# EasyEDA Pro project Cerberus_Sub_Controller_v02.eprj, board Cerberus_Sub_Controller_v02
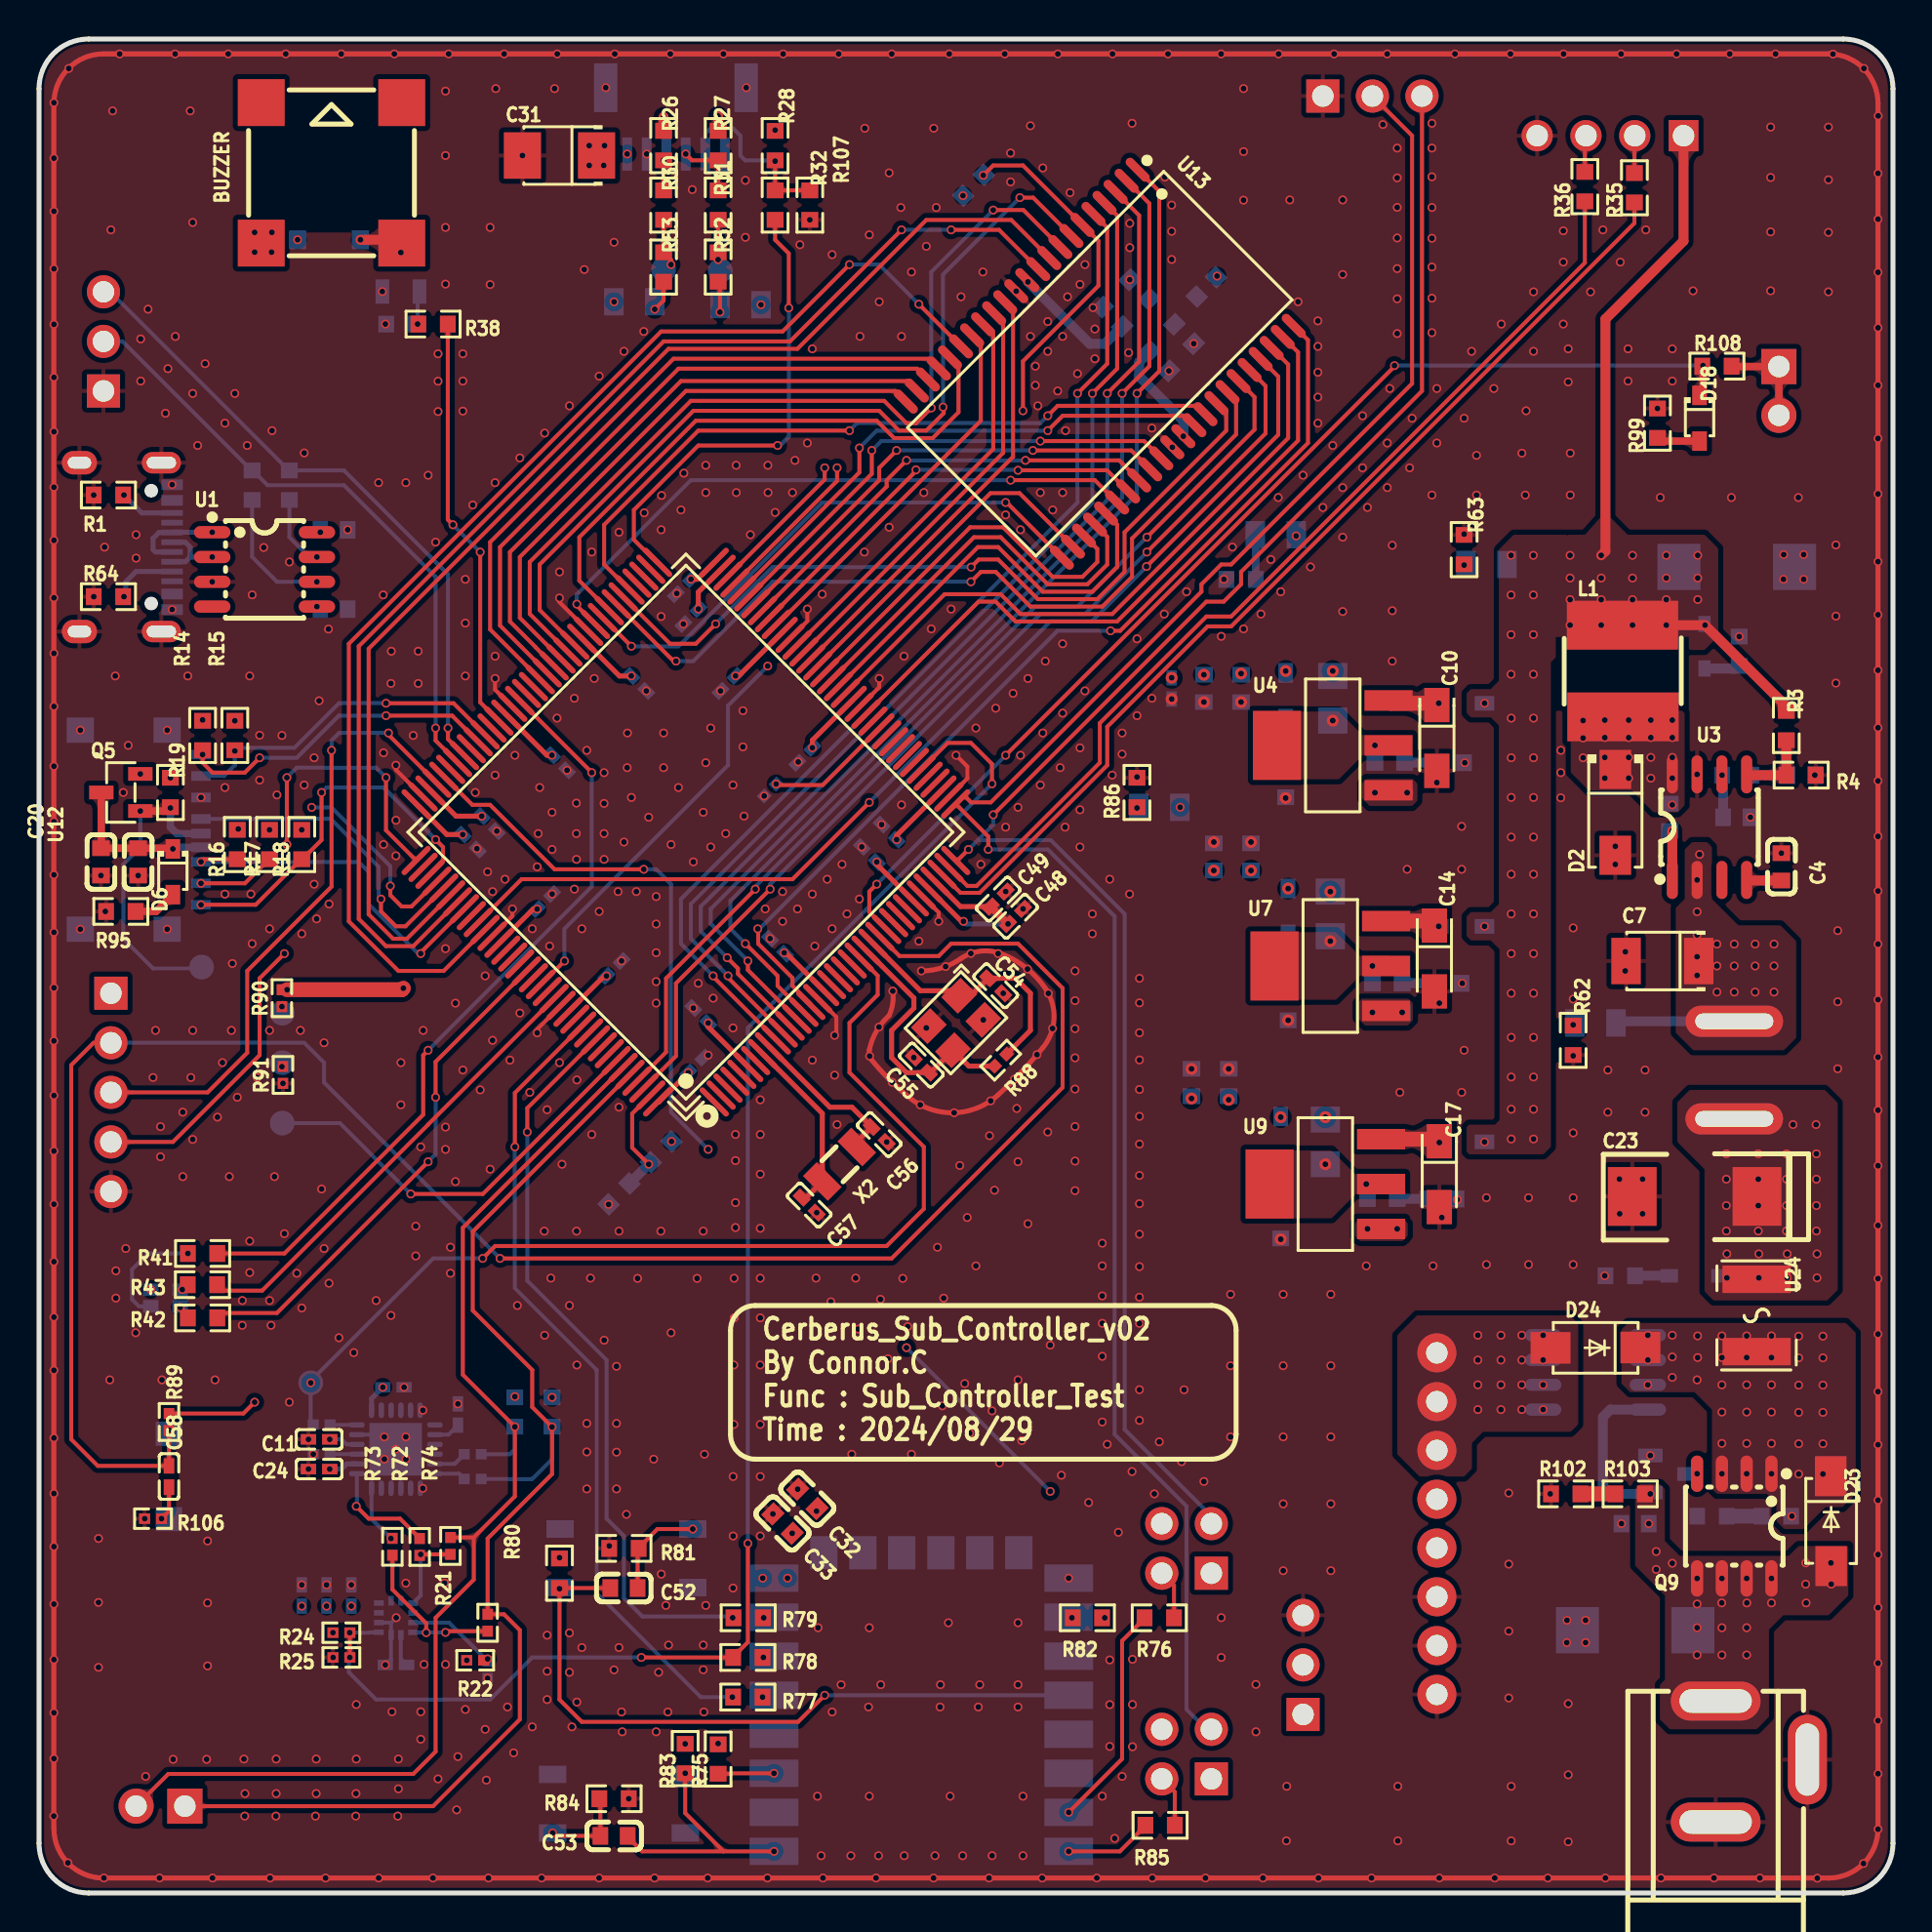
[diagram p3: board, top side]
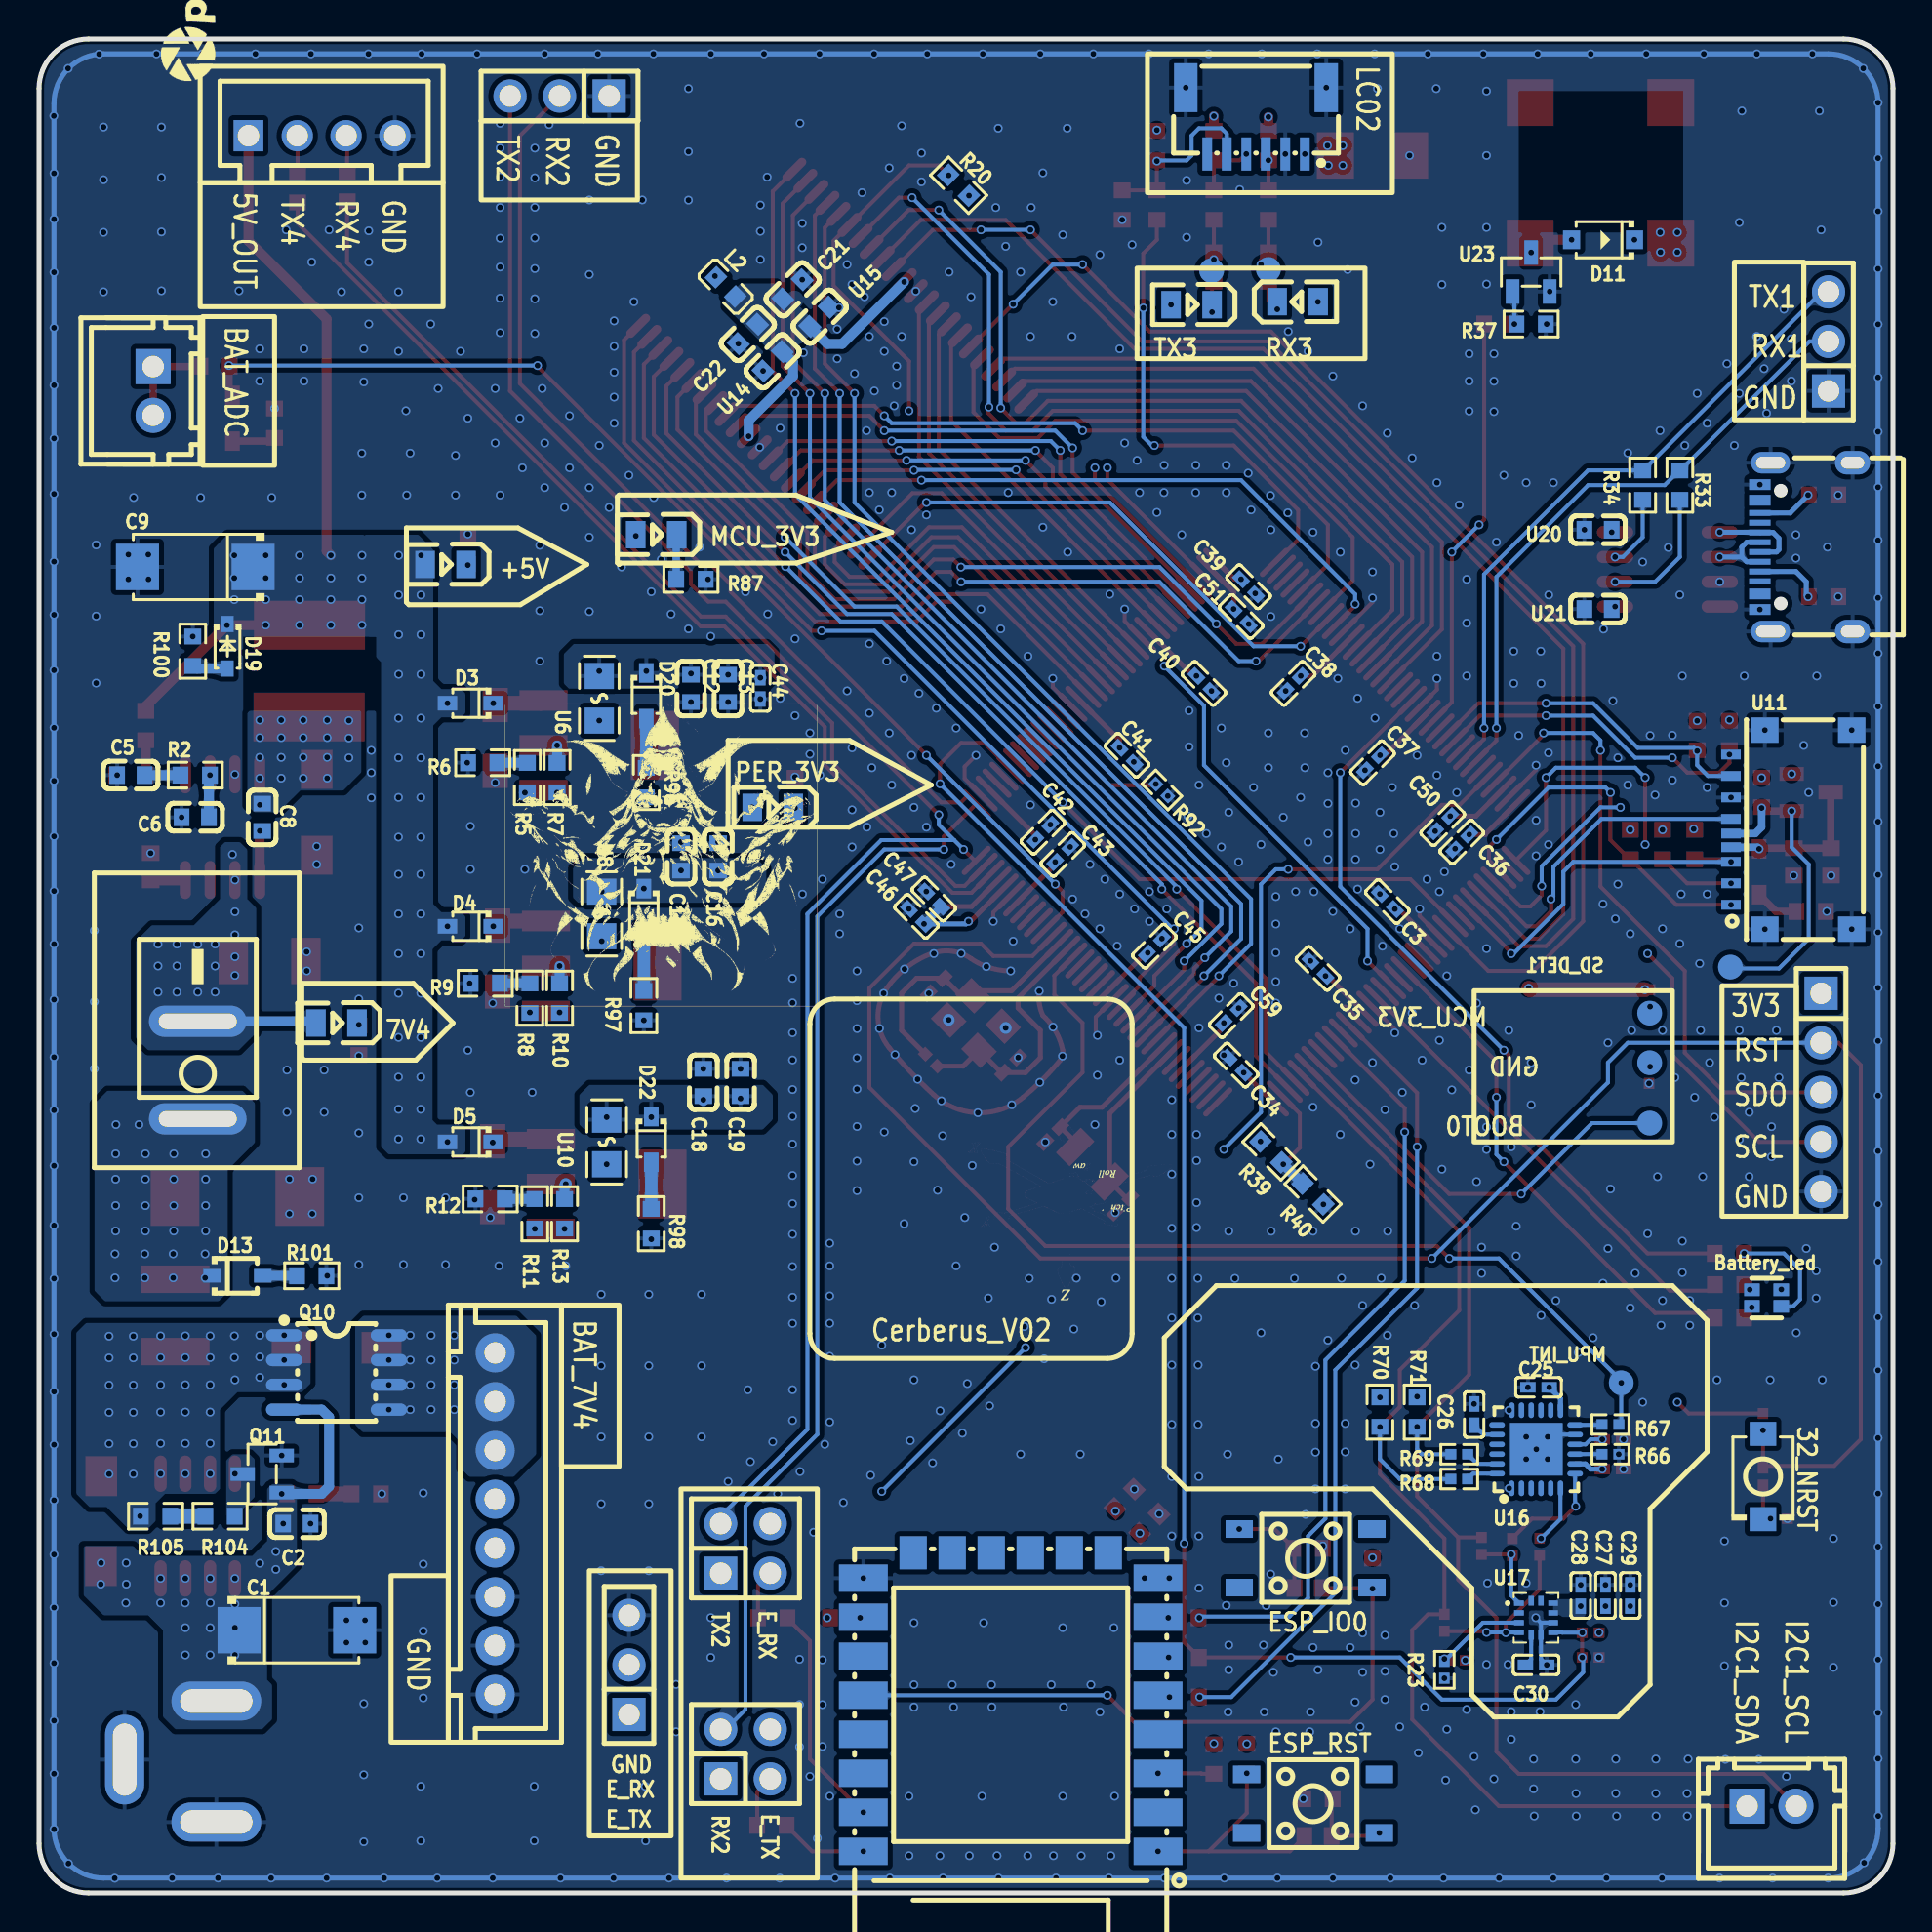
[diagram p4: board, bottom side, seen from below]

Outline 95 x 95 mm; copper layers: Top Layer, Inner1, Inner2, Bottom Layer. Coordinates in mm from the lower left corner of the outline.
Outline path: 0,92.46 0,2.54 arc(0.74,0.74) 2.54,0 92.46,0 arc(94.26,0.74) 95,2.54 95,92.46 arc(94.26,94.26) 92.46,95 2.54,95 arc(0.74,94.26) 0,92.46
Stack: Top Layer 0.035mm 外层铜厚1oz / Dielectric1 0.2104mm 7628 RC49% 8.6mil / Inner1 0.0152mm 内层铜厚 / Dielectric2 1.065mm 1.1mm H/HOZ 含铜 / Inner2 0.0152mm 内层铜厚 / Dielectric3 0.2104mm 7628 RC49% 8.6mil / Bottom Layer 0.035mm 外层铜厚1oz

## Design rules (mm)
template: 自定义配置
spacing copperThickness1oz (default): track to track 0.102, other pairs 0.152 to 0.3
spacing copperThickness2oz: track to track 0.203, other pairs 0.152 to 0.3
track width copperThickness1oz (default): min 0.127, default 0.254, max 5.08
track width copperThickness2oz: min 0.203, default 0.254, max 2.54
differential pair differentialPair (default): width min 0.127, default 0.254, max 2.54; gap min 0.152, default 0.152
via viaSize (default): diameter min 0.45, default 0.61, max 10; hole min 0.3, default 0.305, max 6.299
net VCC_DC_7V4 uses 全铺
net VCC_BAT_7V4 uses 全铺
net VCC_7V4 uses 全铺
net VCC_5V uses 全铺
net $1N4807 uses 全铺
net $1N3446 uses 全铺
net $1N4784 uses 全铺
net $1N4315 uses 全铺
net VCC_PER_3V3 uses 全铺
net $1N4748 uses 全铺
net $1N4721 uses 全铺
net VCC_FSMC_3V3 uses 全铺
net $1N11173 uses 全铺
net $1N19262 uses 全铺
net $1N19049 uses 全铺
net $1N2585 uses 全铺

## Placement (name value [footprint] x y rotation side)
7V4  NCD0805R1  [LED0805-R-RD]  79.76 44.58 0 bottom
32_NRST  TS-1088R-02026  [SW-SMD_L3.9-W3.0-P4.45]  6.66 21.34 270 bottom
+5V  NCD0805R1  [LED0805-R-RD]  74.17 68.08 0 bottom
Battery_led  XL-1615RGBC-RF  [LED-ARRAY-SMD_4P-L1.6-W1.5-BR_XL-1615RGBC-RF]  6.48 30.48 180 bottom
BOOT0  -  [Test-Point-0.5mm]  12.46 39.45 0 top
BUZZER  2.7kHz  [BUZ-SMD_4P-L8.5-W8.5-P8.50-BR]  14.99 88.14 0 top
C1  100uF  [CAP-SMD_L6.0-W3.2-R-RD]  81.79 13.47 0 bottom
C2  10uF  [C0603]  81.79 18.93 0 bottom
C3  100nF  [C0402]  25.91 50.8 225 bottom
C4  8.2nF  [C0603]  89.28 52.58 270 top
C5  1nF  [C0603]  90.3 57.28 180 bottom
C6  10pF  [C0603]  87 55.12 180 bottom
C7  22uF  [CASE-B_3528]  83.19 47.76 180 top
C8  100nF  [C0603]  83.57 55.12 90 bottom
C9  47uF  [CAP-SMD_L6.0-W3.2-R-RD]  87 67.95 180 bottom
C10  10uF  [CAP-SMD_L3.2-W1.6-RD-C7171]  71.63 59.19 270 top
C11  100nF  [C0402]  14.35 23.25 0 top
C12  10uF  [C0603]  61.59 61.73 90 bottom
C13  100nF  [C0603]  59.69 61.73 90 bottom
C14  10uF  [CAP-SMD_L3.2-W1.6-RD-C7171]  71.5 47.88 270 top
C15  10uF  [C0603]  62.1 53.09 270 bottom
C16  100nF  [C0603]  60.2 53.09 270 bottom
C17  10uF  [CAP-SMD_L3.2-W1.6-RD-C7171]  71.75 36.83 270 top
C18  10uF  [C0603]  60.96 41.53 270 bottom
C19  100nF  [C0603]  59.06 41.53 270 bottom
C20  10uF  [C0603]  3.17 52.84 90 top
C21  22uF  [C0603]  56.39 82.17 315 bottom
C22  4.7uF  [C0603]  58.67 79.89 135 bottom
C23  220uF  [CASE-E_7343]  84.84 35.69 0 top
C24  100nF  [C0402]  14.35 21.72 0 top
C25  100nF  [C0402]  18.16 25.91 0 bottom
C26  2.2nF  [C0402]  21.46 24.51 90 bottom
C27  10uF  [C0402]  14.73 15.24 270 bottom
C28  100nF  [C0402]  16 15.24 90 bottom
C29  100nF  [C0402]  13.46 15.24 90 bottom
C30  220nF  [C0402]  18.29 11.69 0 bottom
C31  220uF  [CAP-SMD_L3.5-W2.8-R-RD]  26.67 89.03 0 top
C32  10uF  [C0603]  39.37 20.2 315 top
C33  100nF  [C0603]  38.1 18.93 315 top
C34  100nF  [C0402]  33.66 42.42 225 bottom
C35  100nF  [C0402]  29.46 47.38 225 bottom
C36  100nF  [C0402]  22.1 53.85 135 bottom
C37  100nF  [C0402]  26.67 57.92 135 bottom
C38  100nF  [C0402]  30.73 61.98 135 bottom
C39  100nF  [C0402]  33.02 66.93 45 bottom
C40  100nF  [C0402]  35.31 61.98 45 bottom
C41  100nF  [C0402]  39.24 58.3 45 bottom
C42  100nF  [C0402]  43.56 54.36 315 bottom
C43  100nF  [C0402]  42.54 53.22 315 bottom
C44  4.7uF  [C0402]  58.04 61.73 90 bottom
C45  100nF  [C0402]  37.85 48.52 315 bottom
C46  1uF  [C0402]  50.04 50.04 225 bottom
C47  100nF  [C0402]  49.15 50.93 225 bottom
C48  1uF  [C0402]  50.04 50.04 225 top
C49  100nF  [C0402]  49.15 50.93 225 top
C50  2.2uF  [C0402]  23.07 54.8 135 bottom
C51  2.2uF  [C0402]  33.4 65.41 45 bottom
C52  100nF  [C0603]  29.97 15.62 0 top
C53  100nF  [C0603]  29.46 2.93 180 top
C54  12pF  [C0402]  49.02 46.49 135 top
C55  12pF  [C0402]  45.21 42.42 315 top
C56  12pF  [C0402]  43.05 38.87 135 top
C57  12pF  [C0402]  39.47 35.25 135 top
C58  100nF  [C0402]  6.66 21.34 270 top
C59  100nF  [C0402]  33.91 44.96 135 bottom
CN3  SH1.0_1X6P  [CONN-SMD_6P-P1.00_XUNPU_WAFER-SH1.0-6PWB]  32.64 90.81 0 bottom
CN4  XH2.54 2P  [CONN-TH_2P-P2.50_HX25003-2A]  6.22 4.45 180 bottom
CN5  XH2.54-8P  [CONN-TH_8P-P2.50-XH2.54-8P]  71.63 18.93 90 bottom
CN6  XH2.54-2P  [CONN-TH_2P-P2.50_HX25003-2A]  89.15 76.97 270 bottom
D2  SS24A  [SMA_L4.4-W2.6-LS5.1-FD]  80.77 55.38 90 top
D3  1N5819WS  [SOD-323_L1.8-W1.3-LS2.5-RD]  72.9 60.96 0 bottom
D4  1N5819WS  [SOD-323_L1.8-W1.3-LS2.5-RD]  72.9 49.53 0 bottom
D5  1N5819WS  [SOD-323_L1.8-W1.3-LS2.5-RD]  72.9 38.48 0 bottom
D6  MM3Z3V3T1G  [SOD-323_L1.8-W1.3-LS2.5-RD]  6.86 52.33 270 top
D11  1N4148W  [SOD-123_L2.7-W1.6-LS3.7-FD]  14.86 84.71 180 bottom
D13  BZT52C9V1S  [SOD-323_L1.6-W1.3-LS2.7-RD]  84.84 31.63 180 bottom
D18  MM3Z3V3T1G  [SOD-323_L1.8-W1.3-LS2.5-RD]  85.09 75.57 270 top
D19  BZT52C5V1S  [SOD-323_L1.7-W1.3-LS2.6-RD]  85.34 63.89 270 bottom
D20  MM3Z3V3T1G  [SOD-323_L1.8-W1.3-LS2.5-RD]  63.88 61.34 270 bottom
D21  MM3Z3V3T1G  [SOD-323_L1.8-W1.3-LS2.5-RD]  64.01 50.3 270 bottom
D22  MM3Z3V3T1G  [SOD-323_L1.8-W1.3-LS2.5-RD]  63.63 38.61 270 bottom
D23  SS54  [SMA_L4.3-W2.6-LS5.0-FD]  91.82 19.05 90 top
D24  SS54  [SMA_L4.3-W2.6-LS5.0-FD]  79.76 27.94 0 top
DC1  DC005  [DC-IN-TH_DC005]  88.26 6.74 90 top
ESP_IO0  TS-1009S-04526  [SW-SMD_4P-L4.5-W4.5-P3.00-LS7.0]  30.1 17.15 0 bottom
ESP_RST  TS-1009S-04526  [SW-SMD_4P-L4.5-W4.5-P3.00-LS7.0]  29.72 4.58 180 bottom
GND  -  [Test-Point-0.5mm]  12.47 42.54 0 top
H4  PZ254V-11-03P  [HDR-TH_3P-P2.54-V-M]  68.33 92.08 0 bottom
H8  PZ254V-12-4P  [HDR-TH_4P-P2.54-V-M-R2-C2-S2.54]  58.8 7.12 180 bottom
H9  PZ254V-12-4P  [HDR-TH_4P-P2.54-V-M-R2-C2-S2.54]  58.8 17.66 180 bottom
H10  PZ254V-11-03P  [HDR-TH_3P-P2.54-V-M]  64.77 11.69 90 bottom
H11  PZ254V-11-03P  [HDR-TH_3P-P2.54-V-M]  3.3 79.51 90 bottom
H12  PZ254V-11-05P  [HDR-TH_5P-P2.54-V-M]  3.68 41.03 270 bottom
L1  4.5uH  [IND-SMD_L6.0-W6.0_FNR60XXS]  81.15 62.61 90 top
L2  600R 100Mhz  [L0603]  59.82 82.3 225 bottom
MCU_3V3  -  [Test-Point-0.5mm]  12.47 45.08 0 top
MCU_3V3#2  -  [LED0805-R-RD]  63.37 69.6 0 bottom
MPU_INT  -  [Test-Point-0.5mm]  13.92 26.14 0 top
PER_3V3  NCD0805R1  [LED0805-R-RD]  57.4 55.63 0 bottom
Q5  SI2305CDS-T1-GE3  [SOT-23-3_L2.9-W1.3-P1.90-LS2.4-BR]  4.19 56.39 0 top
Q9  AO4407C  [SOP-8_L4.9-W3.9-P1.27-LS6.0-BL]  86.87 18.8 180 top
Q10  AO4407C  [SOP-8_L4.9-W3.9-P1.27-LS6.0-BL]  79.76 26.67 270 bottom
Q11  AO3400A  [SOT-23-3_L2.9-W1.3-P1.90-LS2.4-BR]  83.57 21.47 180 bottom
R1  5.1kΩ  [R0603]  3.56 71.63 180 top
R2  66.5kΩ  [R0603]  87 57.28 180 bottom
R3  10kΩ  [R0603]  89.53 59.82 90 top
R4  1.91kΩ  [R0603]  90.3 57.28 180 top
R5  330Ω  [R0603]  69.98 57.15 90 bottom
R6  3kΩ  [R0603]  72.26 57.92 0 bottom
R7  2kΩ  [R0603]  68.45 57.15 90 bottom
R8  330Ω  [R0603]  69.85 45.85 90 bottom
R9  3kΩ  [R0603]  72.14 46.61 0 bottom
R10  2kΩ  [R0603]  68.33 45.85 90 bottom
R11  330Ω  [R0603]  69.6 34.8 90 bottom
R12  3kΩ  [R0603]  71.88 35.56 0 bottom
R13  2kΩ  [R0603]  68.07 34.8 90 bottom
R14  51kΩ  [R0603]  8.38 59.31 90 top
R15  51kΩ  [R0603]  10.03 59.31 90 top
R16  51kΩ  [R0603]  10.16 53.72 90 top
R17  51kΩ  [R0603]  11.81 53.72 90 top
R18  51kΩ  [R0603]  13.46 53.72 90 top
R19  10kΩ  [R0603]  6.73 56.39 90 top
R20  10kΩ  [R0603]  47.88 87.51 45 bottom
R21  NC  [R0402]  22.99 13.85 90 top
R22  4.7kΩ  [R0402]  22.35 11.92 180 top
R23  NC  [R0402]  22.99 11.43 90 bottom
R24  4.7kΩ  [R0402]  15.49 13.34 180 top
R25  NC  [R0402]  15.49 12.07 0 top
R26  1kΩ  [R0603]  32 89.54 90 top
R27  1kΩ  [R0603]  34.8 89.54 90 top
R28  1kΩ(NC)  [R0603]  37.72 89.54 90 top
R30  0Ω  [R0603]  32 86.49 90 top
R31  0Ω  [R0603]  34.8 86.49 90 top
R32  0Ω(NC)  [R0603]  37.72 86.49 90 top
R33  0Ω  [R0603]  10.92 72.14 270 bottom
R34  0Ω  [R0603]  12.83 72.14 270 bottom
R35  0Ω  [R0603]  81.75 87.38 90 top
R36  0Ω  [R0603]  79.21 87.44 90 top
R37  10kΩ  [R0603]  18.54 80.39 0 bottom
R38  470Ω  [R0603]  20.19 80.39 180 top
R39  10kΩ  [R0603]  31.88 37.98 45 bottom
R40  10kΩ(NC)  [R0603]  29.72 35.82 45 bottom
R41  470Ω  [R0603]  8.38 32.77 180 top
R42  330Ω  [R0603]  8.38 29.47 0 top
R43  100Ω  [R0603]  8.37 31.17 0 top
R52  1kΩ  [R0603]  34.8 83.32 90 top
R53  1kΩ  [R0603]  32 83.32 90 top
R62  2kΩ  [R0603]  78.61 43.69 270 top
R63  1kΩ  [R0603]  73.03 68.84 90 top
R64  5.1kΩ  [R0603]  3.56 66.42 180 top
R66  10kΩ  [R0402]  14.48 22.48 0 bottom
R67  100Ω  [R0402]  14.48 24.01 0 bottom
R68  100Ω  [R0402]  22.22 21.21 0 bottom
R69  100Ω  [R0402]  22.22 22.48 0 bottom
R70  4.7kΩ  [R0603]  26.29 24.64 90 bottom
R71  4.7kΩ  [R0603]  24.38 24.64 90 bottom
R72  0Ω  [R0402]  19.5 17.73 90 top
R73  0Ω  [R0402]  18.11 17.74 90 top
R74  NC  [R0402]  21.08 17.78 90 top
R75  10kΩ  [R0603]  34.8 6.86 270 top
R76  0Ω  [R0603]  57.4 14.1 0 top
R77  0Ω  [R0603]  36.32 10.04 180 top
R78  0Ω  [R0603]  36.32 12.07 180 top
R79  0Ω  [R0603]  36.34 14.1 180 top
R80  10kΩ  [R0603]  26.67 16.39 90 top
R81  10kΩ  [R0603]  29.97 17.66 0 top
R82  0Ω  [R0603]  53.72 14.1 0 top
R83  10kΩ  [R0603]  33.11 6.89 90 top
R84  10kΩ  [R0603]  29.46 4.83 180 top
R85  0Ω  [R0603]  57.45 3.47 0 top
R86  1kΩ  [R0603]  56.26 56.39 90 top
R87  1kΩ  [R0603]  61.59 67.31 180 bottom
R88  1MΩ  [R0402]  49.28 42.68 45 top
R89  10kΩ  [R0402]  6.66 24.14 270 top
R90  10kΩ  [R0402]  12.45 45.85 90 top
R91  10kΩ  [R0402]  12.5 41.92 90 top
R92  10kΩ  [R0402]  37.47 56.52 45 bottom
R95  10kΩ  [R0603]  4.19 50.3 0 top
R96  10kΩ  [R0603]  63.88 56.9 90 bottom
R97  10kΩ  [R0603]  64.01 45.47 90 bottom
R98  10kΩ  [R0603]  63.63 34.29 90 bottom
R99  10kΩ  [R0603]  82.93 75.31 270 top
R100  10kΩ  [R0603]  87.12 63.63 270 bottom
R101  10kΩ  [R0603]  81.03 31.63 0 bottom
R102  200kΩ  [R0603]  78.23 20.45 0 top
R103  510kΩ  [R0603]  81.53 20.45 0 top
R104  510kΩ  [R0603]  85.72 19.31 0 bottom
R105  200kΩ  [R0603]  89.03 19.31 0 bottom
R106  10kΩ  [R0402]  5.84 19.18 180 top
R107  1kΩ  [R0603]  39.5 86.49 90 top
R108  100Ω  [R0603]  85.98 78.24 180 top
RX3  NCD0805R1  [LED0805-R-RD]  30.51 81.54 180 bottom
SD_DET1  -  [Test-Point-0.5mm]  8.33 47.45 90 top
SW2  KCD11-2P-R  [SW-TH_2P-L15.0-W10.5-P5.00_KCD11-2P-R]  86.87 42.17 90 bottom
TP19  -  [Test-Point-0.5mm]  34.91 83.14 0 top
TP20  -  [Test-Point-0.5mm]  32 83.19 0 top
TX3  NCD0805R1  [LED0805-R-RD]  35.94 81.39 0 bottom
U1  CH340N  [SOP-8_L4.9-W3.9-P1.27-LS6.0-BL]  11.56 67.82 270 top
U3  TPS54331DR  [SOIC-8_L5.0-W4.0-P1.27-LS6.0-BL]  85.6 54.61 0 top
U4  LM1117IMPX-3.3/NOPB  [SOT-223_L6.5-W3.5-P2.30-LS7.0-BR]  66.29 58.81 0 top
U6  SMD0805B050TF  [F0805]  66.29 61.22 90 bottom
U7  LM1117IMPX-3.3/NOPB  [SOT-223_L6.5-W3.5-P2.30-LS7.0-BR]  66.17 47.5 0 top
U8  SMD0805B050TF  [F0805]  66.17 50.17 90 bottom
U9  LM1117IMPX-3.3/NOPB  [SOT-223_L6.5-W3.5-P2.30-LS7.0-BR]  65.91 36.33 0 top
U10  SMD0805B050TF  [F0805]  65.91 38.48 90 bottom
U11  TF-123-ARP9H17  [TF-SMD_TF-123-ARP9H15]  5.21 54.49 270 bottom
U12  100nF  [C0603]  5.08 52.84 90 top
U13  IS62WV51216BLL-55TLI  [TSOP-44_L18.4-W10.2-P0.80-LS11.8-BL]  54.36 78.36 225 top
U14  100nF  [C0603]  57.4 78.49 135 bottom
U15  100nF  [C0603]  55.01 80.77 315 bottom
U16  MPU-6050  [QFN-24_L4.0-W4.0-P0.50-BL-EP2.7]  18.29 22.74 180 bottom
U17  LIS2MDLTR  [LGA-12_L2.0-W2.0-P0.50-BL]  18.29 14.1 270 bottom
U20  100nF  [C0603]  15.11 69.85 180 bottom
U21  100nF  [C0603]  15.11 65.79 180 bottom
U22  XH2.54 1X4P  [CONN-TH_4P-P2.50_4PIN]  80.52 90.05 180 bottom
U23  SS8050  [SOT-23-3_L2.9-W1.3-P1.90-LS2.4-BR]  18.54 83.06 270 bottom
U24  1812L300/16GR  [F1812]  88.01 29.59 90 top
U30  2.4GHz  [WIFIM-SMD_ESP-12F-ESP8266MOD]  45.21 9.78 90 bottom
U31  STM32F407ZET6  [LQFP-144_L20.0-W20.0-P0.50-LS22.0-BL]  33.15 54.36 45 top
USB1  TYPE-C 16PIN 2MD(073)  [USB-C-SMD_TYPE-C-6PIN-2MD-073]  4.44 68.97 90 bottom
X1  8MHz  [OSC-SMD_4P-L3.2-W2.5-BL]  46.99 44.58 225 top
X2  32.768kHz  [FC-135R_L3.2-W1.5]  41.02 37.34 45 top

## Footprints (pads in the part's own frame, mm; a bottom-side part is the same pattern mirrored in y, then rotated)
BUZ-SMD_4P-L8.5-W8.5-P8.50-BR
  rect 2.4x2.4 smd: 1(-3.6,-3.6) 2(3.6,-3.6) 3(3.599,3.599) 4(-3.6,3.6)
C0402
  rect 0.79x0.54 smd: 1(-0.545,0) 2(0.545,0)
C0603
  rect 0.8x0.9 smd: 1(-0.7,0) 2(0.7,0)
CAP-SMD_L3.2-W1.6-RD-C7171
  rect 1.758x1.296 smd: 1(-1.687,0) 2(1.687,0)
CAP-SMD_L3.5-W2.8-R-RD
  rect 1.9x2.376 smd: 1(1.899,0) 2(-1.899,0)
CAP-SMD_L6.0-W3.2-R-RD
  rect 2.208x2.376 smd: 1(2.961,0) 2(-2.961,0)
CASE-B_3528
  rect 1.506x2.376 smd: 1(-1.861,0) 2(1.861,0)
CASE-E_7343
  rect 2.5x3.01 smd: 1(3.196,0) 2(-3.196,0)
CONN-SMD_6P-P1.00_XUNPU_WAFER-SH1.0-6PWB
  rect 0.5x1.7 smd: 1(-2.5,1.7) 2(-1.5,1.7) 3(-0.5,1.7) 4(0.5,1.7) 5(1.5,1.7) 6(2.5,1.7)
  rect 1.2x2.5 smd: 7(3.6,-1.7) 8(-3.6,-1.7)
CONN-TH_2P-P2.50_HX25003-2A
  rect 1.8x1.8 hole 1.1: 1(-1.25,0)
  round 1.8 hole 1.1: 2(1.25,0)
CONN-TH_4P-P2.50_4PIN
  rect 1.524x1.6 hole 1.1: 1(-3.75,0)
  round 1.6 hole 1.1: 2(-1.25,0) 3(1.25,0) 4(3.75,0)
CONN-TH_8P-P2.50-XH2.54-8P
  round 2 hole 1.1: 1(8.75,0) 2(6.25,0) 3(3.75,0) 4(1.25,0) 5(-1.25,0) 6(-3.75,0) 7(-6.25,0) 8(-8.75,0)
DC-IN-TH_DC005
  oval 2x4.6 hole 1.2x3.7: 1(3.1,2.35) 2(-3.1,2.35)
  oval 4.6x2 hole 3.7x1.2: 3(0.1,-2.35)
F0805
  rect 1.335x1.5 smd: 1(-1.143,0) 2(1.143,0)
F1812
  rect 1.407x3.499 smd: 1(-1.853,0) 2(1.853,0)
FC-135R_L3.2-W1.5
  rect 1x1.8 smd: 1(-1.25,0) 2(1.25,0)
HDR-TH_3P-P2.54-V-M
  rect 1.7x1.7 hole 1.1: 1(-2.54,0)
  round 1.7 hole 1.1: 2(0,0) 3(2.54,0)
HDR-TH_4P-P2.54-V-M-R2-C2-S2.54
  rect 1.7x1.7 hole 1.1: 1(-1.27,-1.27)
  round 1.7 hole 1.1: 2(-1.27,1.27) 3(1.27,-1.27) 4(1.27,1.27)
HDR-TH_5P-P2.54-V-M
  rect 1.7x1.7 hole 1.1: 1(-5.08,0)
  round 1.7 hole 1.1: 2(-2.54,0) 3(0,0) 4(2.54,0) 5(5.08,0)
IND-SMD_L6.0-W6.0_FNR60XXS
  rect 2.5x5.7 smd: 1(-2.35,-0.013) 2(2.35,0.013)
L0603
  rect 0.8x0.864 smd: 1(-0.7,0) 2(0.7,0)
LED0805-R-RD
  rect 1x1.399 smd: 1(1.05,0) 2(-1.05,0)
LED-ARRAY-SMD_4P-L1.6-W1.5-BR_XL-1615RGBC-RF
  rect 0.8x0.65 smd: 1(0.75,-0.425) 2(0.75,0.425) 3(-0.75,0.425) 4(-0.75,-0.425)
LGA-12_L2.0-W2.0-P0.50-BL
  rect 0.28x0.5 smd: 1(-0.75,-0.875) 2(-0.25,-0.875) 3(0.25,-0.875) 4(0.75,-0.875) 7(0.75,0.875) 8(0.25,0.875) 9(-0.25,0.875) 10(-0.75,0.875)
  rect 0.5x0.28 smd: 5(0.875,-0.25) 6(0.875,0.25) 11(-0.875,0.25) 12(-0.875,-0.25)
LQFP-144_L20.0-W20.0-P0.50-LS22.0-BL
  oval 0.28x2 smd: 1(-8.75,-10.8) 2(-8.25,-10.8) 3(-7.75,-10.8) 4(-7.25,-10.8) 5(-6.75,-10.8) 6(-6.25,-10.8) 7(-5.75,-10.8) 8(-5.25,-10.8) 9(-4.75,-10.8) 10(-4.25,-10.8) 11(-3.75,-10.8) 12(-3.25,-10.8) 13(-2.75,-10.8) 14(-2.25,-10.8) 15(-1.75,-10.8) 16(-1.25,-10.8) 17(-0.75,-10.8) 18(-0.25,-10.8) 19(0.25,-10.8) 20(0.75,-10.8) 21(1.25,-10.8) 22(1.75,-10.8) 23(2.25,-10.8) 24(2.75,-10.8) 25(3.25,-10.8) 26(3.75,-10.8) 27(4.25,-10.8) 28(4.75,-10.8) 29(5.25,-10.8) 30(5.75,-10.8) 31(6.25,-10.8) 32(6.75,-10.8) 33(7.25,-10.8) 34(7.75,-10.8) 35(8.25,-10.8) 36(8.75,-10.8) 73(8.75,10.8) 74(8.25,10.8) 75(7.75,10.8) 76(7.25,10.8) 77(6.75,10.8) 78(6.25,10.8) 79(5.75,10.8) 80(5.25,10.8) 81(4.75,10.8) 82(4.25,10.8) 83(3.75,10.8) 84(3.25,10.8) 85(2.75,10.8) 86(2.25,10.8) 87(1.75,10.8) 88(1.25,10.8) 89(0.75,10.8) 90(0.25,10.8) 91(-0.25,10.8) 92(-0.75,10.8) 93(-1.25,10.8) 94(-1.75,10.8) 95(-2.25,10.8) 96(-2.75,10.8) 97(-3.25,10.8) 98(-3.75,10.8) 99(-4.25,10.8) 100(-4.75,10.8) 101(-5.25,10.8) 102(-5.75,10.8) 103(-6.25,10.8) 104(-6.75,10.8) 105(-7.25,10.8) 106(-7.75,10.8) 107(-8.25,10.8) 108(-8.75,10.8)
  oval 2x0.28 smd: 37(10.8,-8.75) 38(10.8,-8.25) 39(10.8,-7.75) 40(10.8,-7.25) 41(10.8,-6.75) 42(10.8,-6.25) 43(10.8,-5.75) 44(10.8,-5.25) 45(10.8,-4.75) 46(10.8,-4.25) 47(10.8,-3.75) 48(10.8,-3.25) 49(10.8,-2.75) 50(10.8,-2.25) 51(10.8,-1.75) 52(10.8,-1.25) 53(10.8,-0.75) 54(10.8,-0.25) 55(10.8,0.25) 56(10.8,0.75) 57(10.8,1.25) 58(10.8,1.75) 59(10.8,2.25) 60(10.8,2.75) 61(10.8,3.25) 62(10.8,3.75) 63(10.8,4.25) 64(10.8,4.75) 65(10.8,5.25) 66(10.8,5.75) 67(10.8,6.25) 68(10.8,6.75) 69(10.8,7.25) 70(10.8,7.75) 71(10.8,8.25) 72(10.8,8.75) 109(-10.8,8.75) 110(-10.8,8.25) 111(-10.8,7.75) 112(-10.8,7.25) 113(-10.8,6.75) 114(-10.8,6.25) 115(-10.8,5.75) 116(-10.8,5.25) 117(-10.8,4.75) 118(-10.8,4.25) 119(-10.8,3.75) 120(-10.8,3.25) 121(-10.8,2.75) 122(-10.8,2.25) 123(-10.8,1.75) 124(-10.8,1.25) 125(-10.8,0.75) 126(-10.8,0.25) 127(-10.8,-0.25) 128(-10.8,-0.75) 129(-10.8,-1.25) 130(-10.8,-1.75) 131(-10.8,-2.25) 132(-10.8,-2.75) 133(-10.8,-3.25) 134(-10.8,-3.75) 135(-10.8,-4.25) 136(-10.8,-4.75) 137(-10.8,-5.25) 138(-10.8,-5.75) 139(-10.8,-6.25) 140(-10.8,-6.75) 141(-10.8,-7.25) 142(-10.8,-7.75) 143(-10.8,-8.25) 144(-10.8,-8.75)
OSC-SMD_4P-L3.2-W2.5-BL